# EasyEDA Pro project DartCharger.eprj, board PCB1 (continued)
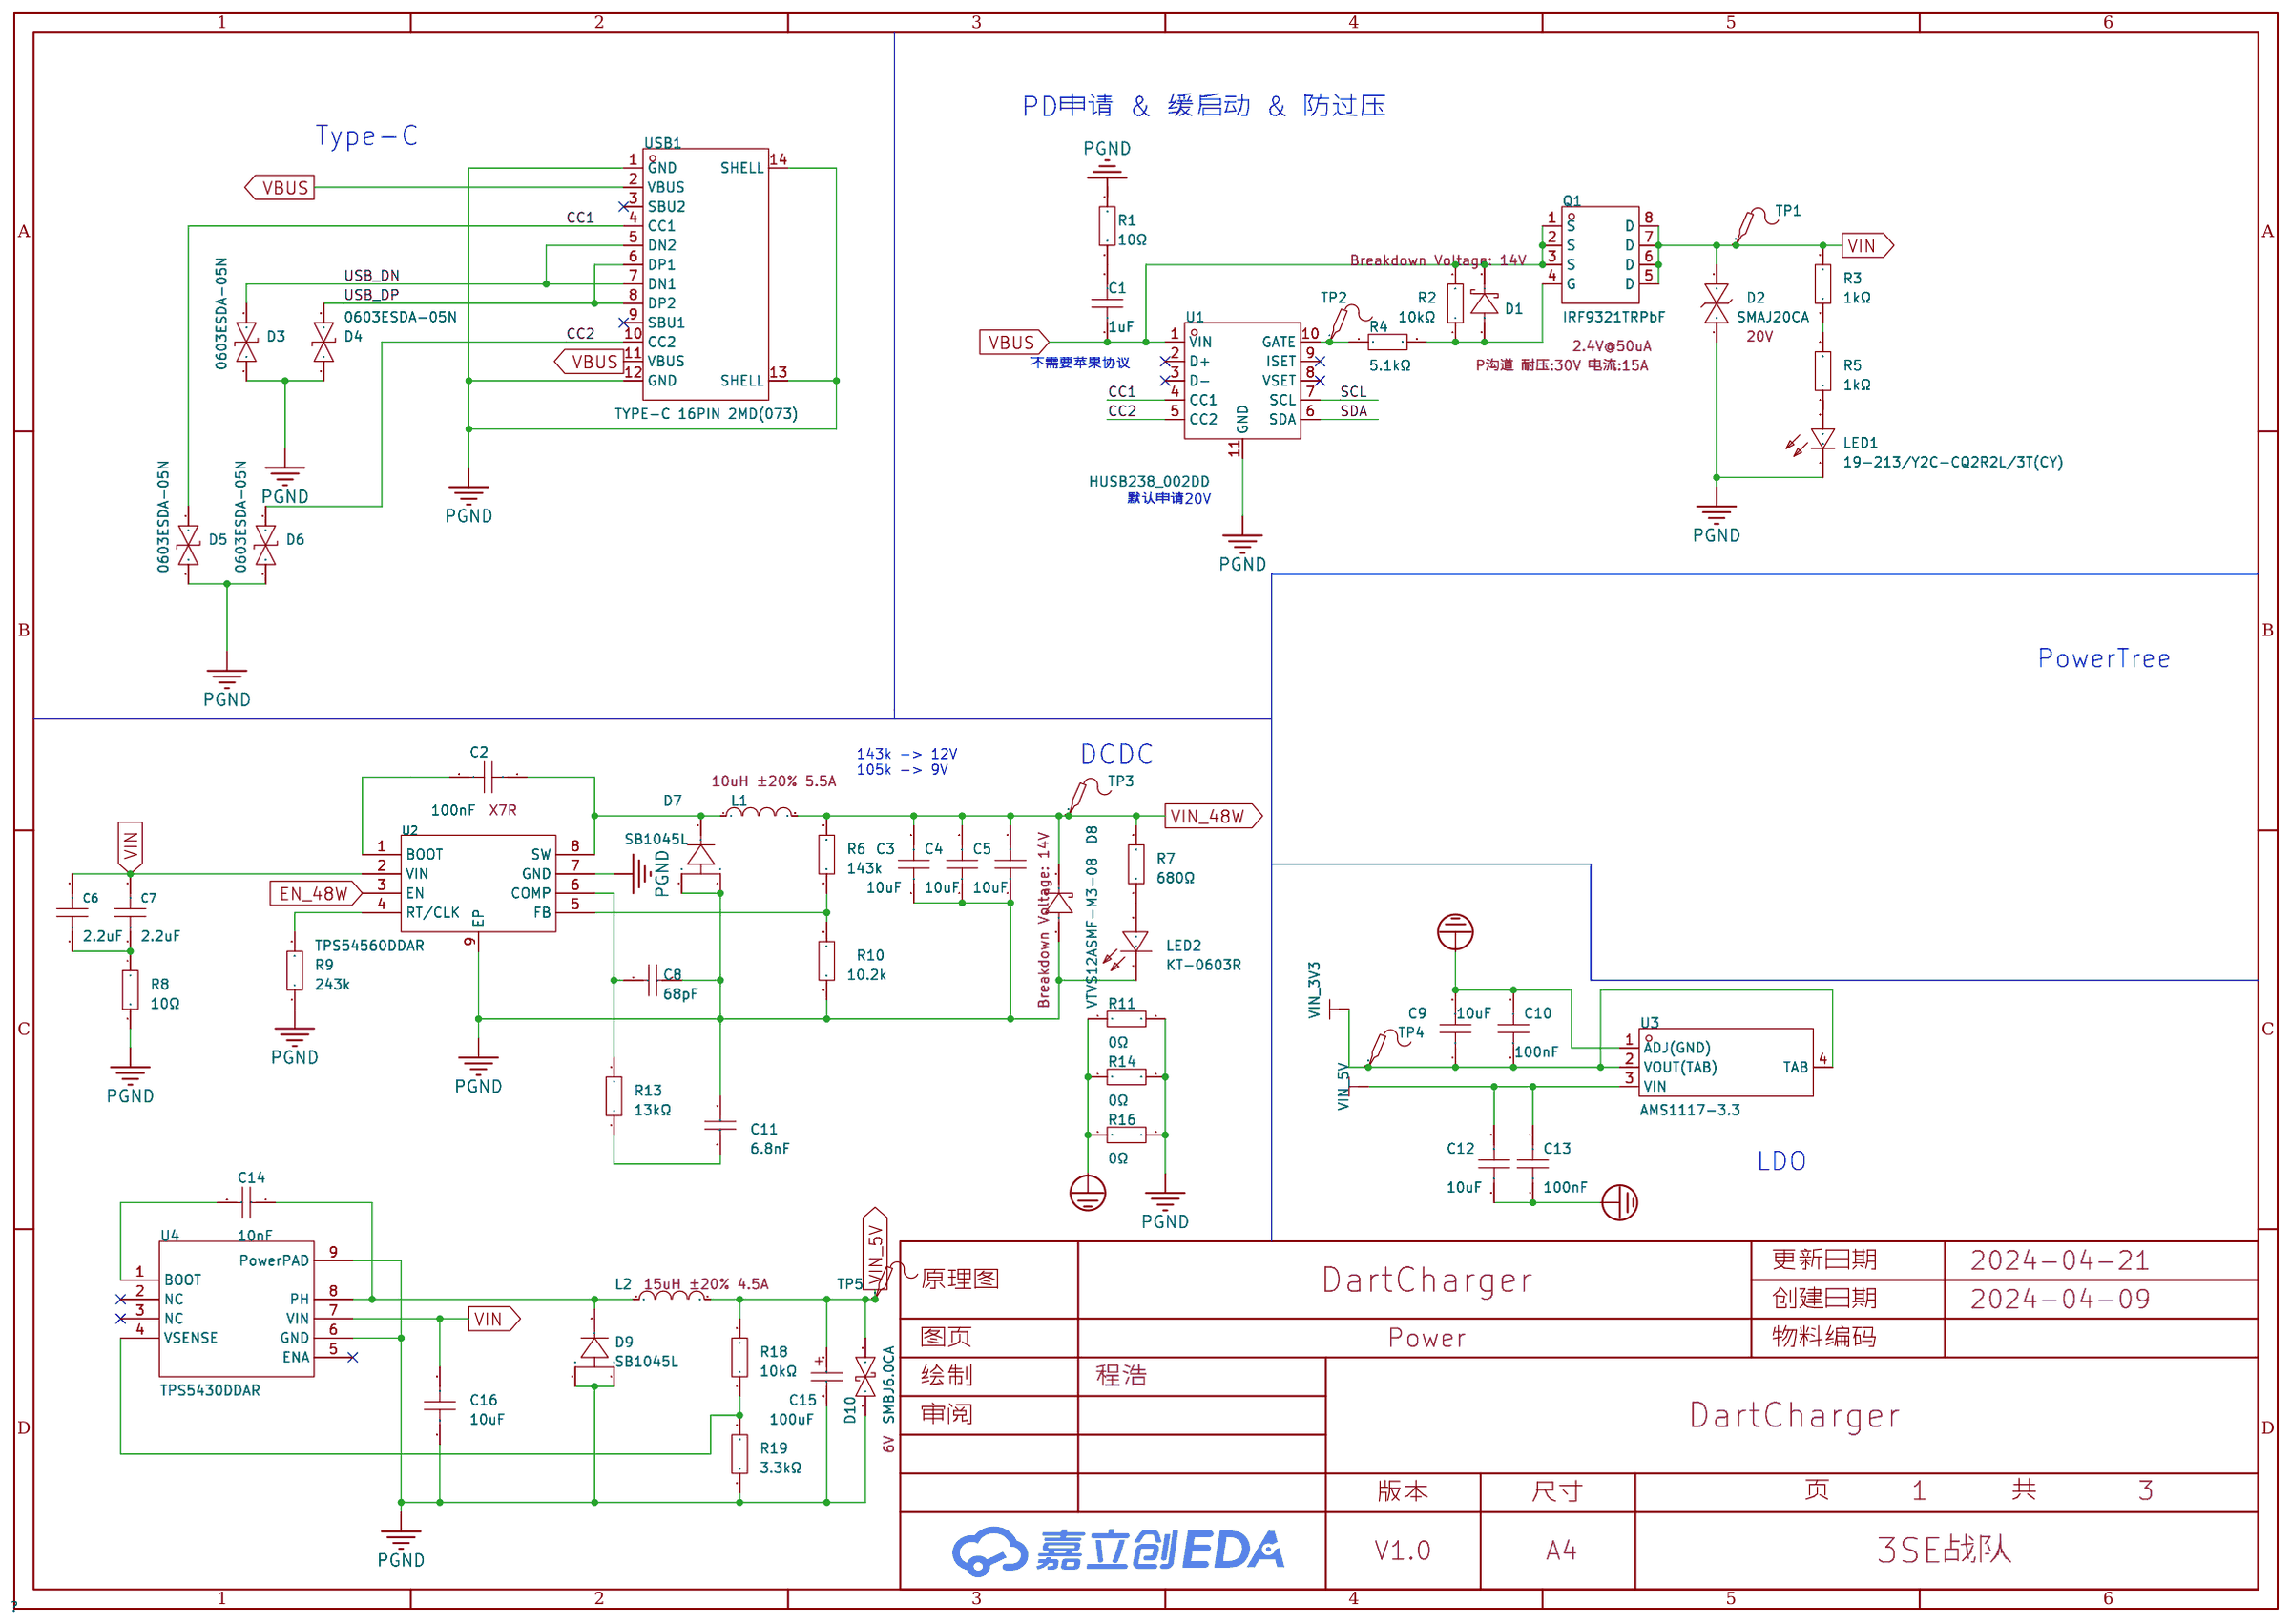
[diagram p0: Power]
## Routing (per net, layer and track width the routed paths; a pad name or vN(x,y) marks a point on that pad's centre or on a via; arc(x,y) is an arc through that point)
DGND:
  vias: v1(41.28,59.28) v1(41.28,44.04) v1(46.35,64.36) v1(46.35,54.2) v1(46.35,49.12) v1(46.35,38.96) v1(51.44,64.36) v1(51.44,59.28) v1(51.44,33.88) v1(56.51,64.36) v1(56.51,59.28) v1(56.51,54.2) v1(56.51,49.12) v1(56.51,44.04) v1(56.51,33.88) v1(56.51,28.8) v1(61.59,49.12) v1(61.59,44.04) v1(61.59,38.96) v1(61.59,28.8) v1(66.68,28.8) v1(71.75,64.36) v1(76.84,64.36) v1(76.84,59.28) v1(81.91,64.36) v1(81.91,59.28) v1(87,8.48) v2(52.14,30.31) v2(53.59,59.65) v2(55.5,57.87) v2(58.67,30.31) v2(60.07,27.64) v2(60.32,60.79) v2(61.49,60.79) v2(61.59,35.13) v2(62.99,30.31) v2(64.77,39.33) v2(65.53,33.99) v2(65.93,62.73) v2(66.04,49.99) v2(68.2,42.75) v2(68.83,32.34) v2(69.34,33.99) v2(69.98,42.12) v2(70.1,50.88) v2(71.5,42.5) v2(71.63,39.07) v2(71.75,48.6) v2(72.52,57.36) v2(72.9,44.66) v2(73.15,39.58) v2(73.66,43.64) v2(73.79,40.47) v2(74.93,24.85) v2(75.69,54.18) v2(75.69,33.86) v2(75.82,35.52) v2(76.45,31.83) v2(76.58,44.28) v2(76.84,42.88) v2(76.84,40.47) v2(77.6,54.31) v2(77.72,29.04) v2(78.36,40.34) v2(78.74,44.53) v2(80.01,23.45) v2(80.39,40.34) v2(81.66,36.15) v2(83.19,30.56)
PGND: length 7.8
  Top Layer w0.5: 28.7,23.73 28.7,25.86 28.07,26.5
  Top Layer w0.762: U4.9 22.9,49.69 U4.6 22.9,46.07 C16.1
  vias: v1(4.86,59.89) v1(4.86,55.81) v1(4.86,51.73) v1(4.86,47.65) v1(4.86,43.57) v1(4.86,39.48) v1(4.86,35.41) v1(4.86,31.33) v1(4.86,23.17) v1(8.94,55.81) v1(8.94,51.73) v1(8.94,47.65) v1(8.94,43.57) v1(8.97,63.97) v1(8.97,59.89) v1(13.02,55.81) v1(13.02,51.73) v1(13.02,47.65) v1(13.02,19.09) v1(13.02,15.01) v1(13.02,2.77) v1(17.1,55.81) v1(17.1,47.65) v1(17.1,19.09) v1(17.1,6.84) v1(21.18,63.97) v1(21.18,51.73) v1(21.18,27.25) v1(21.18,19.09) v1(21.18,15.01) v1(25.26,63.97) v1(25.26,6.84) v1(25.26,2.77) v1(29.34,63.97) v1(29.34,43.57) v1(33.42,63.97) v1(33.42,43.57) v1(33.42,2.77) v1(37.5,19.09) v1(37.5,6.84) v1(41.58,39.48) v1(41.58,19.09) v1(41.58,15.01) v1(45.66,35.41) v1(45.66,6.84) v1(45.66,2.77) v1(53.82,19.09) v1(53.82,2.77) v1(57.9,19.09) v1(57.9,6.84) v1(61.98,19.09) v1(61.98,15.01) v1(66.06,6.84) v1(66.06,2.77) v1(74.22,19.09) v1(74.22,2.77) v1(78.3,6.84) v1(82.38,6.84) v2(6.22,12.78) v2(6.22,12.78) v2(6.22,12.78) v2(6.22,12.78) v2(6.22,12.78) v2(11.56,34.37) v2(13.08,37.8) v2(13.46,38.44) v2(13.97,37.8) v2(14.35,38.44) v2(14.73,29.67) v2(14.84,37.8) v2(15.62,32.72) v2(21.05,24.09) v2(22.26,50.96) v2(22.26,49.69) v2(23.15,50.96) v2(23.15,49.69) v2(24.04,50.96) v2(24.04,49.69) v2(24.26,32.98) v2(24.93,50.96) v2(24.93,49.69) v2(25.4,30.18) v2(26.55,12.58) v2(26.55,12.58) v2(26.55,12.58) v2(26.55,12.58) v2(26.55,12.58) v2(31.88,24.09) v2(44.45,25.86) v2(46.99,12.91) v2(46.99,12.91) v2(46.99,12.91) v2(46.99,12.91) v2(46.99,12.91) v2(64.77,14.94) v2(67.19,12.96) v2(67.19,12.96) v2(67.19,12.96) v2(67.19,12.96) v2(67.19,12.96) v2(77.98,13.16) v2(78.87,13.8)
VBUS: length 30.6
  Top Layer w0.127: U1.1 15.37,34.15 C1.1
  Top Layer w0.4: C1.1 15.37,35.86 D1.2 R2.2
  Top Layer w0.6: Q1.1 14.86,27.77 18.29,31.2 18.29,34.72 D1.2 17.14,37.29 15.13,39.31 USB1.2
VIN: length 5.8
  Top Layer w0.127: 5.85,25.61 7.65,23.81 D2.2
  Top Layer w0.762: U4.7 24.17,45.94 C16.2
VIN_3V3: length 103.5
  Top Layer w0.127: v2(79.12,41.1) R69.2 ; R65.1 v2(79.5,38.56) ; v2(79.5,38.56) 79.5,33.61 v2(78.99,33.1) ; v2(79.5,38.56) 79.56,38.56 ; C69.1 58.84,35.17 R64.1 59.87,34.25 v2(61.47,34.25) ; v2(75.56,27.9) 75.56,32.59 76.07,33.1 ; v2(71.25,33.48) R68.2
  Top Layer w0.254: J7.2 63.35,63.75 63.01,64.09 58.17,64.09 v2(55.75,61.68) ; C9.1 48.01,42.39 48.01,37.55 50.42,35.13 57.24,35.13 C70.1 C69.1 58.54,35.18 U9.2
  Top Layer w0.5: U3.4 U3.2 39.44,53.74 40.77,55.07 v2(41.69,55.07) 42.64,55.07 TP4.1
  Bottom Layer w0.127: v2(75.56,27.9) 71.25,32.21 v2(71.25,33.48) 69.98,34.75 69.98,35.87 68.53,37.32 67.22,37.32 64.14,34.25 v2(61.47,34.25) ; v2(79.12,41.1) 79.12,38.94 v2(79.5,38.56) ; v2(76.2,33.1) v2(78.99,33.1)
  Bottom Layer w0.254: v2(41.69,55.07) 48.29,61.68 v2(55.75,61.68)
VIN_5V: length 113
  Top Layer w0.127: 23.88,54.52 25.11,54.52 26.5,55.92 C15.1
  Top Layer w0.254: J6.4 45.63,62.77 LED11.3 40.97,62.05 TP5.1 ; R66.2 17.86,43.08 v2(20.19,45.42)
  Top Layer w0.5: U3.3 37.14,55.23 v2(37.07,55.3) 37.08,55.3 C13.1
  Bottom Layer w0.254: v2(20.19,45.42) 20.57,45.8 20.57,54.18 22.64,56.25 v2(26.18,56.25)
  Bottom Layer w0.3: J1.2 79.48,63.58 34.29,63.58 v2(31.5,60.79)
  Bottom Layer w0.5: v2(37.07,55.3) 27.84,55.3 v2(26.92,56.22)
  vias: v2(26.18,57.74) v2(26.16,56.98) v2(26.92,57.74) v2(26.92,56.98)
VIN_48W: length 53
  Top Layer w1: J8.2 17.89,52.41 C72.2
  Bottom Layer w0.254: J8.2 17.91,49.87 17.91,45.04 24.26,38.69 32.46,38.69 L1.2 39.04,37.5 v2(39.75,36.79) ; v2(39.75,34.37) 32.89,34.37 29.73,37.54 v2(24.26,37.54)
  vias: v2(9.4,18.62) v2(9.4,17.75) v2(9.4,16.72) v2(9.4,15.75) v2(10.41,18.62) v2(10.4,17.75) v2(10.41,16.72) v2(10.4,15.75) v2(33.78,21.42) v2(33.78,20.22) v2(34.78,21.42) v2(34.78,20.22) v2(35.78,21.42) v2(35.78,20.22) v2(36.78,21.42) v2(36.78,20.22) v2(37.78,21.42) v2(37.78,20.22) v2(38.78,21.42) v2(38.78,20.22) v2(39.78,21.42) v2(39.78,20.22) v2(40.78,21.42) v2(40.78,20.22)
B3: length 31.4
  Bottom Layer w0.127: J1.30 80.26,27.24 80.26,33.23 73.27,40.23 73.27,42.61 73.66,43.01 75.18,43.01 75.82,43.64 75.82,47.07 v2(75.69,47.2)
B4: length 46.1
  Top Layer w0.127: v2(68.58,45.68) 70.97,45.68 72.26,44.38 72.26,43.9 v2(73.79,42.37)
  Bottom Layer w0.127: J1.31 86.11,21.39 86.11,25.61 85.47,26.24 83.57,26.24 81.28,28.53 81.28,35.52 77.47,39.33 77.47,41.33 76.42,42.39 73.8,42.39 v2(73.79,42.37) ; v2(68.7,54.3) 68.58,54.18 v2(68.58,45.68)
B5: length 23.5
  Bottom Layer w0.127: J1.32 84.65,20.08 73.28,31.45 73.28,34.25 70.74,36.79 69.98,36.79
  vias: v2(69.97,36.8)
B6: length 28.5
  Bottom Layer w0.127: J1.33 86.08,18.88 83.44,18.88 68.58,33.74 v2(68.58,36.53) 68.71,36.66
B7: length 29.3
  Top Layer w0.127: U9.18 75.69,42.37 v2(76.2,41.87) ; v2(78.36,36.91) 78.36,24.06 J1.34
  Bottom Layer w0.127: v2(78.36,36.91) 76.2,39.07 v2(76.2,41.87)
BOOT: length 52.1
  Top Layer w0.127: SW2.1 70.04,64.54 68.33,62.82 68.33,60.53 73.78,55.08 U9.27 74.32,54.83 78.98,54.83 80.9,52.91 v2(80.9,48.85)
  Bottom Layer w0.127: v2(80.9,48.85) 82.3,48.85 84.33,46.82 88.26,46.82 89.03,46.06 89.03,35.13 88.01,34.12 86.22,34.12 J1.22
CC1: length 9.6
  Top Layer w0.127: U1.4 13.27,34.7 D5.2 12.71,35.47 12.21,35.98 12.21,37.66 11.7,38.16 USB1.4
CC2: length 6.5
  Top Layer w0.127: USB1.10 8.73,35.16 10.81,33.09 D6.2 12.31,33.09 U1.5
CTP_IRQ: length 37
  Bottom Layer w0.127: J1.1 86.22,56.98 81.26,56.98 73.67,49.39 70.64,49.39 69.72,48.47 69.72,45.44 v2(61.08,36.8)
CTP_RST: length 15.9
  Top Layer w0.127: J1.6 83.06,51.28 83.06,47.58 79.12,43.64 U9.19
DE: length 45.9
  Top Layer w0.127: U9.5 62.35,27.9 64.39,25.86 73.15,25.86 82.55,16.47
  Bottom Layer w0.127: v2(82.55,16.34) 83.44,15.45 83.44,9.61 84.46,8.59 86.09,8.59 J1.39
DISP: length 36.8
  Top Layer w0.127: v2(76.33,30.18) 76.33,23.55 J1.36
  Bottom Layer w0.127: v2(76.33,30.18) 74.93,31.58 74.93,33.1 74.55,33.48 74.55,35.52 72.26,37.8 72.26,43.01 74.17,44.91 75.06,44.91
  vias: v2(75.06,44.91)
EC11_CLK: length 15
  Top Layer w0.127: J7.3 62.1,59.67 TP8.1 63.26,58.5 67.92,58.5 71.24,55.18 U9.29
EC11_DT: length 14.8
  Top Layer w0.127: J7.4 60.86,62.76 TP6.1 60.86,59.49 62.87,57.49 67.18,57.49 69.97,54.7 U9.30
EC11_SW: length 21.6
  Top Layer w0.127: J7.5 59.58,62.74 TP7.1 59.56,59.67 v2(59.56,58.38) ; v2(65.78,60.92) 66.71,60.92 72.51,55.11 U9.28
  Bottom Layer w0.127: v2(59.56,58.38) 61.59,58.38 64.13,60.92 v2(65.78,60.92)
EN_48W: length 45.4
  Top Layer w0.127: U9.8 66.17,36.79 v2(66.17,32.21) ; R70.2 v2(50.16,29.67)
  Bottom Layer w0.127: v2(27.44,28.91) 28.21,29.67 v2(50.16,29.67) 63.4,29.67 65.94,32.21 v2(66.17,32.21)
FAN_PWM: length 70.1
  Top Layer w0.127: R67.2 v2(67.44,36.28) 67.44,36.79 U9.9
  Top Layer w0.254: v2(12.86,44.97) 12.53,44.65 D15.2
  Bottom Layer w0.127: v2(67.44,36.28) 67.44,34.5 63.88,30.94 23.75,30.94 18.8,35.9 18.8,39.45 17.78,40.47 16,40.47 12.86,43.61 v2(12.86,44.97)
G2: length 36
  Top Layer w0.127: 83.69,36.53 85.6,36.53 86.11,36.02 86.11,34.09 J1.21 ; v2(76.33,53.04) 76.71,53.04 79.5,50.25 v2(79.5,48.09)
  Bottom Layer w0.127: v2(83.61,36.51) 83.32,36.79 83.32,43.38 79.5,47.2 v2(79.5,48.09) ; v2(67.44,54.31) 67.94,54.82 69.22,54.82 70.99,53.04 v2(76.33,53.04)
G4: length 30.6
  Top Layer w0.127: v2(77.6,46.31) 78.87,47.58 78.87,49.36 75.69,52.53 U9.26
  Bottom Layer w0.127: v2(77.6,46.31) 77.94,45.96 77.94,44.03 79.77,42.21 79.77,39.06 82.93,35.9 82.93,31.83 83.31,31.45 86.21,31.45 J1.23
G5: length 25.4
  Top Layer w0.127: v2(82.8,38.56) 83.09,38.28 83.09,32.03 J1.24 ; U9.25 75.56,51.26 v2(78.23,48.6)
  Bottom Layer w0.127: v2(82.8,38.56) 82.8,43.39 78.23,47.96 v2(78.23,48.6)
G6: length 29.3
  Top Layer w0.127: U9.24 75.69,49.99 v2(76.96,48.72) ; J1.25 86.21,28.91 83.57,28.91 82.18,30.3 82.18,38.3 v2(81.91,38.56)
  Bottom Layer w0.127: v2(81.91,38.56) 81.91,43.74 76.96,48.7 v2(76.96,48.72)
G7: length 29.1
  Top Layer w0.127: v2(78.99,45.93) 77.85,44.79 77.09,44.79 76.33,45.55 76.33,48.22 75.82,48.72 U9.23 ; v2(81.03,38.69) 81.03,30.18 83.51,27.7 J1.26
  Bottom Layer w0.127: v2(78.99,45.93) 81.03,43.9 v2(81.03,38.69)
HSYNC: length 41.5
  Top Layer w0.127: J1.37 89.03,14.07 89.03,38.94 88.77,39.2 81.79,39.2 81.41,39.58 75.32,39.58 U9.16
LCD_PWM: length 30.6
  Bottom Layer w0.127: J1.7 86.34,49.48 76.33,49.48 74.05,47.21 72.15,47.21 71.61,46.67 71.61,44.77 63.63,36.79
  vias: v2(63.62,36.8)
PCLK: length 34.2
  Top Layer w0.127: v2(66.17,31.07) 64.89,32.34 U9.7
  Bottom Layer w0.127: J1.35 86.08,16.34 84.65,16.34 69.91,31.07 v2(66.17,31.07)
R3: length 46.1
  Top Layer w0.127: v2(74.93,55.45) 79.25,55.45 81.42,53.28 81.42,48.61 81.03,48.22 80.54,48.22 77.88,45.55 v2(77.34,45.55) ; v2(79.25,41.99) 79.77,42.51 84.45,42.51 J1.14
  Bottom Layer w0.127: v2(74.93,55.45) 67.56,55.45 66.8,54.69 66.8,54.06 66.17,53.42 59.44,53.42 v2(58.55,54.31) ; v2(79.25,41.99) 78.61,41.99 77.34,43.26 v2(77.34,45.55)
R4: length 38.7
  Top Layer w0.127: v2(80.14,48.72) 80.14,51.01 77.47,53.68 v2(76.96,53.68)
  Bottom Layer w0.127: v2(80.14,48.72) 80.14,48.67 84.53,44.28 85.85,44.28 86.23,43.9 86.23,41.59 J1.15 ; v2(76.96,53.68) 76.96,54.95 75.93,55.98 67.32,55.98 65.12,53.78 60.35,53.78 v2(59.82,54.31)
R5: length 33.3
  Top Layer w0.127: J1.16 83.29,41.99 v2(80.39,41.99) ; v2(73.03,46.69) 72.64,47.07 64.52,47.07 63.62,47.97 U9.35
  Bottom Layer w0.127: v2(73.03,46.69) 74.29,46.69 75.76,48.15 76.52,48.15 78.36,46.31 78.36,45.83 80.39,43.8 v2(80.39,41.99)
R6: length 42.9
  Top Layer w0.127: v2(82.04,47.71) 82.42,48.09 82.42,55.07 80.26,57.23 v2(76.96,57.23)
  Bottom Layer w0.127: v2(82.04,47.71) 83.19,46.56 85.6,46.56 86.23,45.93 86.23,44.79 86.87,44.15 88.14,44.15 88.65,43.64 88.65,38.2 88.31,37.86 J1.17 ; 64.9,54.31 66.9,56.32 74.78,56.32 75.69,57.23 v2(76.96,57.23)
  vias: v2(64.89,54.3)
R7: length 41.7
  Top Layer w0.127: v2(77.72,56.34) 79.63,56.34 81.91,54.06 81.91,48.47 80.77,47.33 v2(80.77,47.07) ; v2(66.17,56.6) 66.17,54.3 U9.33
  Bottom Layer w0.127: v2(77.72,56.34) 77.72,57.49 77.22,57.99 66.68,57.99 66.17,57.49 v2(66.17,56.6) ; v2(80.77,47.07) 83.69,44.15 83.69,42.25 84.33,41.61 85.47,41.61 86.23,40.85 86.23,39.07 85.02,37.86 J1.18
RST: length 62.2
  Top Layer w0.127: U9.3 59.82,36.79 v2(59.82,36.79) R64.2 ; SW1.1 70.04,60.09 70.87,59.26 v2(72.4,59.26) 72.86,59.26 C71.1
  Bottom Layer w0.127: v2(72.4,59.26) 64.26,59.26 61.59,56.6 50.67,56.6 48.64,54.57 48.64,37.42 50.55,35.52 55.14,35.52 56.41,36.79 v2(59.82,36.79)
RXD0: length 14.4
  Top Layer w0.127: J6.1 52.8,61.58 57.15,57.23 60.58,57.23 62.35,55.46 U9.36
SCL: length 97.7
  Top Layer w0.127: J1.5 87.42,52.83 86.23,51.64 86.23,50.12 85.6,49.48 84.58,49.48 83.69,48.6 83.69,47.37 77.43,41.1 R69.1 U9.17 v2(71.63,41.1) ; v2(13.59,29.8) 13.27,30.11 U1.7 ; v2(56.51,32.34) 56.51,32.09 v2(53.34,28.91)
  Bottom Layer w0.127: v2(53.34,28.91) 43.31,28.91 39.24,24.85 14.86,24.85 13.45,23.44 12.08,23.44 11.94,23.58 11.94,28.15 v2(13.59,29.8) ; v2(71.63,41.1) 69.47,41.1 64.26,35.9 61.47,35.9 57.91,32.34 v2(56.51,32.34)
SDA: length 105
  Top Layer w0.127: U1.6 12.7,30.67 v2(12.7,29.8) ; v2(69.47,30.18) 69.47,32.85 70.16,33.54 70.16,34.1 R68.1 71.25,36.79 U9.12 71.24,37.93 70.87,38.31 v2(70.87,45.04)
  Bottom Layer w0.127: v2(12.7,29.8) 11.05,28.15 11.05,23.58 11.68,22.94 40,22.94 45.34,28.28 67.56,28.28 v2(69.47,30.18) ; v2(70.87,45.04) 70.87,47.2 71.54,47.88 73.7,47.88 81.47,55.64 J1.4
TXD0: length 14.7
  Top Layer w0.127: J6.2 51.69,62.63 51.69,60.53 56.01,56.22 59.98,56.22 61.08,55.11 U9.37
USB_DN: length 104.2
  Top Layer w0.127: U9.13 72.51,35.9 72.77,35.64 74.54,35.64 74.78,35.41 74.78,28.65 72.91,26.78 71.86,26.78 v2(71.37,27.26) ; USB1.5 6.21,37.66 v2(5.72,37.17) 6.22,36.66 USB1.7 9.15,36.66 D3.2
  Bottom Layer w0.127: v2(71.37,27.26) 71.12,27.01 46.47,27.01 41.92,22.46 11.04,22.46 10.31,23.18 10.31,36.69 10.55,36.93 10.55,37.51 10.25,37.81 9.82,37.81 9.17,37.17 v2(5.72,37.17)
USB_DP: length 104.1
  Top Layer w0.127: U9.14 75.06,35.52 75.06,28.53 73.03,26.5 v2(71.37,26.5) ; v2(8.51,35.77) 8.12,36.16 USB1.8 ; USB1.6 9.9,37.16 v2(10.03,37.29)
  Bottom Layer w0.127: v2(71.37,26.5) 71.15,26.73 70.85,26.73 70.73,26.6 70.73,26.5 70.6,26.37 70.35,26.37 70.23,26.5 70.23,26.6 70.1,26.73 69.85,26.73 69.73,26.6 69.73,26.5 69.6,26.37 69.35,26.37 69.23,26.5 69.23,26.6 69.1,26.73 68.85,26.73 68.73,26.6 68.73,26.5 68.6,26.37 68.35,26.37 68.23,26.5 68.23,26.6 68.1,26.73 67.85,26.73 67.73,26.6 67.73,26.5 67.6,26.37 67.35,26.37 67.23,26.5 67.23,26.6 67.1,26.73 66.85,26.73 66.73,26.6 66.73,26.5 66.6,26.37 66.35,26.37 66.23,26.5 66.23,26.6 66.1,26.73 65.85,26.73 65.73,26.6 65.73,26.5 65.6,26.37 65.35,26.37 65.23,26.5 65.23,26.6 65.1,26.73 64.85,26.73 64.73,26.6 64.73,26.5 64.6,26.37 64.35,26.37 64.23,26.5 64.23,26.6 64.1,26.73 63.85,26.73 63.73,26.6 63.73,26.5 63.6,26.37 63.35,26.37 63.23,26.5 63.23,26.6 63.1,26.73 62.85,26.73 62.73,26.6 62.73,26.5 62.6,26.37 62.35,26.37 62.23,26.5 62.23,26.6 62.1,26.73 61.85,26.73 61.73,26.6 61.73,26.5 61.6,26.37 61.35,26.37 61.23,26.5 61.23,26.6 61.1,26.73 60.85,26.73 60.73,26.6 60.73,26.5 60.6,26.37 60.35,26.37 60.23,26.5 60.23,26.6 60.1,26.73 59.85,26.73 59.73,26.6 59.73,26.5 59.6,26.37 59.35,26.37 59.23,26.5 59.23,26.6 59.1,26.73 58.85,26.73 58.73,26.6 58.73,26.5 58.6,26.37 58.35,26.37 58.23,26.5 58.23,26.6 58.1,26.73 57.85,26.73 57.73,26.6 57.73,26.5 57.6,26.37 57.35,26.37 57.23,26.5 57.23,26.6 57.1,26.73 56.85,26.73 56.73,26.6 56.73,26.5 56.6,26.37 56.35,26.37 56.23,26.5 56.23,26.6 56.1,26.73 55.85,26.73 55.73,26.6 55.73,26.5 55.6,26.37 55.35,26.37 55.23,26.5 55.23,26.6 55.1,26.73 46.58,26.73 42.04,22.18 10.92,22.18 10.03,23.07 v2(10.03,37.29) v2(8.51,35.77)
V_DECODE_1: length 9
  Top Layer w0.25: 11.79,9.32 12.48,9.32 12.83,8.97 12.83,5.73 C17.2
V_DECODE_2: length 9
  Top Layer w0.25: U7.18 73.44,9.5 73.79,9.15 73.79,5.91 C43.2
V_DECODE_3: length 9
  Top Layer w0.25: C18.2 33.15,5.53 33.15,8.77 32.8,9.12 U6.18
V_DECODE_4: length 9
  Top Layer w0.25: U8.18 53.24,9.45 53.59,9.1 53.59,5.86 C44.2
VSYNC: length 32.9
  Top Layer w0.127: J1.38 86.11,13.69 86.11,15.45 85.34,16.21 84.46,16.21 77.1,23.57 R65.2 U9.15
$1N2486: length 3.8
  Top Layer w0.127: U1.10 16.1,30.74 TP2.1 16.17,31.88 16.51,32.21 17.09,32.21 17.14,32.27
$1N2492: length 20.9
  Top Layer w0.127: R4.2 17.5,31.4 17.63,31.53 17.63,33.38 17.45,33.56 R2.1 16.44,33.56 v2(16.38,33.61)
  Bottom Layer w0.127: v2(17.14,39.23) 16.76,38.85 16.76,33.99 v2(16.38,33.61) 16.38,29.93 12.57,26.12 v2(12.57,23.96)
$1N4957: length 3.2
  Top Layer w0.5: C2.2 31.56,27.51 30.73,27.51 29.97,28.28 29.97,29.27
$1N4980: length 7.5
  Top Layer w0.5: C2.1 30.67,25.93 29.97,25.23 29.97,23.73
  Top Layer w0.7: C2.1 35.6,25.93 D7.2
$1N5179: length 1.6
  Top Layer w0.127: U2.4 25.89,29.28 R9.2
$1N5665: length 3.1
  Top Layer w0.127: 27.43,23.48 27.43,22.12 C8.1 27.23,21.92 26.16,21.92 R13.2
$1N5784: length 1.6
  Top Layer w0.127: C11.2 27.26,20.16 R13.1
$1N6075: length 14.5
  Top Layer w0.127: R6.1 R10.2 23.11,33.35 23.11,32.34 23.75,31.71 23.75,25.48 25.76,23.48 26.16,23.48
$1N6298: length 3.4
  Top Layer w0.7: R8.1 C7.1 C6.1
$1N6775: length 2.5
  Top Layer w0.762: U4.1 25.44,52.62 26.53,51.53 C14.2
$1N6972: length 3.2
  Top Layer w0.762: U4.8 25.44,48.25 27.09,49.9 C14.1
$1N7288: length 3
  Top Layer w0.127: R18.1 22.94,54.6 21.67,54.6 21.63,54.56 U4.4
$1N12562: length 4.7
  Top Layer w0.127: R5.1 5.83,27.52 3.3,30.05 2.58,30.05 LED1.2
$1N12564: length 1.5
  Top Layer w0.127: R3.1 4.34,27.12 R5.2
$1N12878: length 2.6
  Top Layer w0.127: LED2.2 45.3,31.05 R7.1
$1N16074: length 1.4
  Top Layer w0.127: R1.1 15.33,36.91 C1.2
$2N1632: length 68.6
  Top Layer w0.127: v2(39.24,62.95) 40.66,64.37 LED11.2 ; U9.21 74.81,45.93 72.42,45.93 72.04,46.31 60.2,46.31 57.4,43.52 57.4,39.2 v2(56.39,38.18) 56.13,37.93 v2(56.13,35.77)
  Bottom Layer w0.127: v2(56.13,35.77) 56.13,35.39 55.75,35.01 50.42,35.01 48.01,37.42 48.01,40.59 39.24,49.36 v2(39.24,62.95)
$2N4593: length 4.4
  Top Layer w0.254: J8.4 15.37,44.06 Q2.3 16.45,44.02
$3N1110: length 3.2
  Top Layer w0.2: U5.2 5.66,11.82 5.46,12.02 5.46,13.03 R22.2
$3N1114: length 2.2
  Top Layer w0.2: R28.2 5.64,11.32 U5.3
$3N1138: length 1.8
  Top Layer w0.2: C25.2 4.7,10.82 U5.4
$3N1317: length 3.7
  Top Layer w0.127: 8.89,7.92 8.89,4.41 8.75,4.27
$3N1478: length 4.5
  Top Layer w0.127: R38.1 9.65,5.49 9.65,1.57 LED3.1 ; 9.44,1.44 9.42,1.47 9.4,1.44 9.44,1.44
$3N1648: length 5.2
  Top Layer w0.127: LED5.1 11.14,1.48 10.92,1.7 R40.1
$3N1651: length 1.3
  Top Layer w0.127: 10.89,7.92 10.92,7.89 10.92,6.61
$3N1655: length 1.3
  Top Layer w0.127: 9.39,7.92 9.4,7.91 9.4,6.61
$3N1793: length 1.3
  Top Layer w0.127: 8.38,6.61 8.38,7.91 8.39,7.92
$3N1853: length 3.1
  Top Layer w0.25: U5.24 12.17,12.32 C33.1
$3N1928: length 2.8
  Top Layer w0.25: C41.2 13.97,8.68 12.83,9.82 U5.19
$3N2551: length 23.2
  Top Layer w0.25: v2(21.72,3.89) 21.39,4.22 R30.1 ; v2(21.72,3.89) R29.2 ; v2(21.72,3.89) C23.2 ; v2(8.76,14.43) 8.39,14.06 8.39,13.22
  Bottom Layer w0.25: v2(8.76,14.43) 9.4,15.07 11.94,15.07 13.08,13.93 13.08,12.53 v2(21.72,3.89)
$3N2696: length 1.4
  Top Layer w0.25: 7.39,13.22 7.39,13.97 C21.2
$3N3059: length 4.6
  Top Layer w0.25: R25.1 17.67,4.22 C19.2 ; C19.2 17.26,4.35 R20.2 ; C19.2 17.46,4.02 C17.1
$3N4796: length 4.2
  Top Layer w0.25: 18.92,5.09 20.19,5.09 20.19,6.13 20.57,6.51 20.57,7.91
$3N4971: length 12.3
  Top Layer w0.127: R28.1 2.03,13.43 2.03,14.43 3.3,15.7 v2(5.84,15.7)
  Top Layer w0.254: U5.5 8.89,10.32 9.14,10.57
  Bottom Layer w0.7: v2(11.05,14.43) 11.05,12.53 10.54,12.02
  vias: v2(5.84,18.37) v2(5.84,17.61) v2(5.84,16.47) v2(6.6,18.37) v2(6.6,17.61) v2(6.6,16.47) v2(6.6,15.7) v2(7.75,12.02) v2(7.75,11.12) v2(7.75,10.22) v2(7.75,9.32) v2(8.65,12.02) v2(8.65,11.12) v2(8.65,10.22) v2(8.65,9.32) v2(9.55,12.02) v2(9.55,11.12) v2(9.55,10.22) v2(9.55,9.32) v2(10.45,12.02) v2(10.45,11.12) v2(10.45,10.22) v2(10.45,9.32)
$3N6138: length 3.2
  Top Layer w0.2: R44.2 66.43,13.21 66.43,12.2 66.63,12 U7.2
$3N6139: length 2.2
  Top Layer w0.2: 67.45,11.5 66.61,11.5 R50.2
$3N6140: length 1.8
  Top Layer w0.2: 67.45,11 65.67,11 C51.2
$3N6141: length 3.7
  Top Layer w0.127: 69.86,8.1 69.86,4.59 69.72,4.45
$3N6142: length 4.5
  Top Layer w0.127: LED7.1 70.62,1.75 70.62,5.67 R60.1 ; 70.36,1.62 70.41,1.62 70.39,1.64 70.36,1.62
$3N6143: length 5.2
  Top Layer w0.127: 73,1.66 72.11,1.66 71.89,1.88 R62.1
$3N6144: length 1.3
  Top Layer w0.127: U7.16 71.89,8.07 R62.2
$3N6145: length 1.3
  Top Layer w0.127: U7.13 70.36,8.09 R60.2
$3N6146: length 1.3
  Top Layer w0.127: U7.11 69.35,8.09 R56.2
$3N6149: length 3.1
  Top Layer w0.25: C59.1 73.14,12.5 U7.24
$3N6150: length 2.8
  Top Layer w0.25: U7.19 73.8,10 74.94,8.86 C67.2
$3N6154: length 24.1
  Top Layer w0.25: U7.30 69.35,14.24 v2(69.73,14.61) ; v2(82.68,4.07) 82.68,2.6 ; v2(82.68,4.07) 82.35,4.4 R52.1 ; v2(82.68,4.07) C49.2
  Bottom Layer w0.25: v2(69.73,14.61) 71,15.88 72.9,15.88 74.05,14.74 74.05,12.71 v2(82.68,4.07)
$3N6155: length 1.4
  Top Layer w0.25: U7.32 68.35,14.14 C47.2
$3N6156: length 4.6
  Top Layer w0.25: C45.2 78.63,4.4 R47.1 ; C45.2 78.23,4.53 R42.2 ; C45.2 78.43,4.2 C43.1
$3N6166: length 4.2
  Top Layer w0.25: R47.2 R52.2 81.16,6.31 81.54,6.69 81.54,8.09
$3N6180: length 11.9
  Top Layer w0.127: v2(66.81,15.88) 64.27,15.88 63.5,15.11 63.5,13.1 R50.1
  Top Layer w0.254: U7.33 69.85,10.5 U7.5
  Bottom Layer w0.7: v2(72.02,14.61) 72.02,12.71 71.51,12.2
  vias: v2(66.81,18.55) v2(66.81,17.79) v2(66.81,16.64) v2(67.57,18.55) v2(67.57,17.79) v2(67.57,16.64) v2(67.57,15.88) v2(68.72,12.2) v2(68.72,11.3) v2(68.72,10.4) v2(68.72,9.5) v2(69.62,12.2) v2(69.62,11.3) v2(69.62,10.4) v2(69.62,9.5) v2(70.52,12.2) v2(70.52,11.3) v2(70.52,10.4) v2(70.52,9.5) v2(71.42,12.2) v2(71.42,11.3) v2(71.42,10.4) v2(71.42,9.5)
$3N7334: length 3.2
  Top Layer w0.2: R23.2 25.79,12.83 25.79,11.82 25.99,11.62 U6.2
$3N7335: length 2.2
  Top Layer w0.2: U6.3 25.97,11.12 R31.2
$3N7336: length 1.8
  Top Layer w0.2: U6.4 25.03,10.62 25.03,10.61
$3N7337: length 3.7
  Top Layer w0.127: 29.08,4.07 29.22,4.21 U6.12
$3N7338: length 4.8
  Top Layer w0.127: R39.1 29.98,5.29 29.98,1.37 29.72,1.37 29.63,1.28 ; 29.77,1.24 29.75,1.26 29.72,1.24 29.77,1.24
$3N7339: length 4.8
  Top Layer w0.127: R41.1 31.25,2.11 31.88,1.48 LED6.1
$3N7340: length 1.3
  Top Layer w0.127: R41.2 31.25,7.68 U6.16
$3N7341: length 1.3
  Top Layer w0.127: U6.13 29.72,7.71 R39.2
$3N7342: length 1.3
  Top Layer w0.127: U6.11 28.71,7.71 R35.2
$3N7345: length 3.1
  Top Layer w0.25: U6.24 32.5,12.12 C34.1
$3N7346: length 2.8
  Top Layer w0.25: U6.19 33.16,9.62 34.3,8.48 C42.2
$3N7350: length 24.1
  Top Layer w0.25: U6.30 28.71,13.86 v2(29.09,14.23) ; R33.1 41.71,4.02 v2(42.04,3.69) ; v2(42.04,3.69) R32.2 ; v2(42.04,3.69) C24.2
  Bottom Layer w0.25: v2(29.09,14.23) 30.36,15.5 32.26,15.5 33.41,14.36 33.41,12.33 v2(42.04,3.69)
$3N7351: length 1.4
  Top Layer w0.25: U6.32 27.71,13.76 C22.2
$3N7352: length 4.6
  Top Layer w0.25: C20.2 37.79,3.82 C18.1 ; C20.2 37.99,4.02 R27.1 ; C20.2 37.59,4.15 R21.2
$3N7362: length 4.2
  Top Layer w0.25: 40.9,7.71 40.9,6.31 40.52,5.93 R33.2 R27.2
$3N7376: length 12
  Top Layer w0.127: v2(26.17,15.5) 23.63,15.5 22.73,14.61 22.73,12.85 R31.1
  Top Layer w0.254: U6.5 29.22,10.12 U6.33
  Bottom Layer w0.7: v2(31.38,14.23) 31.38,12.33 30.87,11.82
  vias: v2(26.17,18.17) v2(26.17,17.41) v2(26.17,16.26) v2(26.93,18.17) v2(26.93,17.41) v2(26.93,16.26) v2(26.93,15.5) v2(28.15,11.82) v2(28.15,10.92) v2(28.15,10.02) v2(28.15,9.12) v2(29.05,11.82) v2(29.05,10.92) v2(29.05,10.02) v2(29.05,9.12) v2(29.95,11.82) v2(29.95,10.92) v2(29.95,10.02) v2(29.95,9.12) v2(30.85,11.82) v2(30.85,10.92) v2(30.85,10.02) v2(30.85,9.12)
$3N8530: length 3.2
  Top Layer w0.2: U8.2 46.43,11.95 46.23,12.15 46.23,13.15 R45.2
$3N8531: length 2.2
  Top Layer w0.2: U8.3 46.41,11.45 R53.2
$3N8532: length 1.8
  Top Layer w0.2: U8.4 45.47,10.95 C55.2
$3N8533: length 3.7
  Top Layer w0.127: 49.52,4.4 49.66,4.54 49.66,8.05
$3N8534: length 4.5
  Top Layer w0.127: R61.1 50.42,5.62 50.42,1.7 LED8.1 ; 50.16,1.57 50.21,1.57 50.19,1.59 50.16,1.57
$3N8535: length 5.2
  Top Layer w0.127: LED10.1 51.91,1.61 51.69,1.83 R63.1
$3N8536: length 1.3
  Top Layer w0.127: R63.2 51.69,8.01 U8.16
$3N8537: length 1.3
  Top Layer w0.127: R61.2 50.16,8.04 50.15,8.05
$3N8538: length 1.3
  Top Layer w0.127: U8.11 49.15,8.04 R57.2
$3N8541: length 3.1
  Top Layer w0.25: C60.1 52.94,12.45 U8.24
$3N8542: length 2.8
  Top Layer w0.25: U8.19 53.6,9.95 54.74,8.81 54.74,8.65
$3N8546: length 24.1
  Top Layer w0.25: v2(49.53,14.56) 49.16,14.19 U8.30 ; v2(62.48,4.02) R54.2 ; v2(62.48,4.02) 62.16,4.35 R55.1 ; v2(62.48,4.02) C50.2
  Bottom Layer w0.25: v2(49.53,14.56) 50.8,15.83 52.71,15.83 53.85,14.69 53.85,12.66 v2(62.48,4.02)
$3N8547: length 1.4
  Top Layer w0.25: U8.32 48.15,14.09 C48.2
$3N8548: length 4.6
  Top Layer w0.25: R49.1 58.43,4.35 C46.2 ; C46.2 58.03,4.47 R43.2 ; C46.2 58.23,4.15 C44.1
$3N8558: length 4.2
  Top Layer w0.25: 61.34,8.03 61.34,6.64 60.96,6.26 R55.2 R49.2
$3N8572: length 12
  Top Layer w0.127: v2(46.61,15.83) 44.07,15.83 43.18,14.94 43.18,13.17 R53.1
  Top Layer w0.254: U8.5 49.66,10.45 U8.33
  Bottom Layer w0.7: v2(51.82,14.56) 51.82,12.66 51.31,12.15
  vias: v2(46.61,18.5) v2(46.61,17.73) v2(46.61,16.59) v2(47.37,18.5) v2(47.37,17.73) v2(47.37,16.59) v2(47.37,15.83) v2(48.52,12.15) v2(48.52,11.25) v2(48.52,10.35) v2(48.52,9.45) v2(49.42,12.15) v2(49.42,11.25) v2(49.42,10.35) v2(49.42,9.45) v2(50.32,12.15) v2(50.32,11.25) v2(50.32,10.35) v2(50.32,9.45) v2(51.22,12.15) v2(51.22,11.25) v2(51.22,10.35) v2(51.22,9.45)

## Copper pours and planes (outline as drawn; the poured copper is in the pictures)
DGND on Top Layer: 36.19,66 36.19,43.01 38.29,40.91 43.12,40.91 47.75,36.28 47.75,27.64 50.1,25.29 72.31,25.29 83.61,13.99 83.61,1.53 86.81,-1.68 91.59,-1.68 92.33,-0.93 92.33,67.77 90.17,69.93 40.13,69.93
DGND on Bottom Layer: 36.19,66 36.19,43.01 38.29,40.91 43.12,40.91 47.75,36.28 47.75,27.64 50.1,25.29 72.31,25.29 83.61,13.99 83.61,1.53 86.81,-1.68 91.59,-1.68 92.33,-0.93 92.33,67.77 90.17,69.93 40.13,69.93
PGND on Top Layer: -0.13,69.3 32.51,69.3 35.81,66 35.81,42.75 38.1,40.47 42.93,40.47 47.24,36.15 47.24,27.51 49.91,24.85 72.04,24.85 83.24,13.65 83.24,1.53 80.39,-1.31 -0.13,-1.31 -3.3,1.86 -3.3,66.12
PGND on Bottom Layer: -0.13,69.3 32.51,69.3 35.81,66 35.81,42.75 38.1,40.47 42.93,40.47 47.24,36.15 47.24,27.51 49.91,24.85 72.04,24.85 83.24,13.65 83.24,1.53 80.39,-1.31 -0.13,-1.31 -3.3,1.86 -3.3,66.12
VBUS on Top Layer: 6.73,34.75 13.33,34.75 13.33,24.59 6.73,24.59
VIN on Top Layer: 7.37,48.26 29.34,48.26 29.34,20.66 7.37,20.66
VIN_3V3 on Top Layer: 37.43,48.6 45.51,48.6 45.51,44.79 37.43,44.79
VIN_5V on Top Layer: 25.4,62.44 34.16,62.44 34.16,55.33 25.4,55.33
VIN_5V on Bottom Layer: 25.75,58.25 27.31,58.25 27.31,55.84 25.75,55.84
VIN_48W on Top Layer: 29.32,39.45 73.03,39.45 73.03,12.45 29.32,12.45
VIN_48W on Top Layer: 9.02,19.27 10.7,19.27 10.7,12.66 9.02,12.66
VIN_48W on Bottom Layer: 8.89,21.8 41.28,21.8 41.28,15.43 8.89,15.43
COIL_1+ on Top Layer: 15.42,14.28 22.38,14.28 22.38,10.9 15.42,10.9
COIL_1- on Top Layer: 11.3,16.85 19.05,16.85 19.05,11.2 11.3,11.2
COIL_2+ on Top Layer: 35.62,13.95 42.58,13.95 42.58,10.57 35.62,10.57
COIL_2- on Top Layer: 31.63,16.64 39.38,16.64 39.38,10.99 31.63,10.99
COIL_3+ on Top Layer: 56.06,14.28 63.02,14.28 63.02,10.9 56.06,10.9
COIL_3- on Top Layer: 52.07,16.97 59.82,16.97 59.82,11.32 52.07,11.32
COIL_4+ on Top Layer: 76.26,14.33 83.22,14.33 83.22,10.96 76.26,10.96
COIL_4- on Top Layer: 72.27,17.03 80.02,17.03 80.02,11.37 72.27,11.37
$1N4980 on Top Layer: 31.5,32.98 38.23,32.98 38.23,23.96 31.5,23.96
$1N6972 on Top Layer: 26.4,55.96 33.91,55.96 33.91,47.15 26.4,47.15
$3N2268 on Top Layer: 11.21,10.91 19.5,10.91 19.5,9.39 11.21,9.39
$3N4971 on Top Layer: 5.39,19.01 8.73,19.01 8.73,15.18 5.39,15.18
$3N4971 on Bottom Layer: 5.33,18.81 11.18,18.81 11.18,8.84 5.33,8.84
$3N6153 on Top Layer: 72.17,11.09 80.47,11.09 80.47,9.57 72.17,9.57
$3N6180 on Top Layer: 66.36,19.18 69.7,19.18 69.7,15.36 66.36,15.36
$3N6180 on Bottom Layer: 66.3,18.98 72.14,18.98 72.14,9.02 66.3,9.02
$3N7349 on Top Layer: 31.53,10.71 39.83,10.71 39.83,9.19 31.53,9.19
$3N7376 on Top Layer: 25.72,18.8 29.06,18.8 29.06,14.98 25.72,14.98
$3N7376 on Bottom Layer: 25.66,18.6 31.5,18.6 31.5,8.64 25.66,8.64
$3N8545 on Top Layer: 51.97,11.04 60.27,11.04 60.27,9.52 51.97,9.52
$3N8572 on Top Layer: 46.16,19.13 49.5,19.13 49.5,15.31 46.16,15.31
$3N8572 on Bottom Layer: 46.1,18.93 51.94,18.93 51.94,8.97 46.1,8.97

Small or netless copper shapes (teardrops, artwork), in the pictures only: 455 on Top Layer, 110 on Bottom Layer

## Text on the board
Bottom Silkscreen Layer: LCD | WLAN
Top Silkscreen Layer: 5V | GND | T | R | SW | A | B | 3V3 | PD | 20V | Wireless | GATE | 24.4 By CH | 3SE | 1.0 | COIL1 | COIL2 | UART | COIL3 | EC11 | COIL4 | 散热区域 | PD 60W | FAN | BOOT | RST | LCD | Dart-Charger
